# EasyEDA Pro project Cerberus_Sub_Controller_v01.eprj, schematic Cerberus_Sub_Controller_v01

## Sheets
1 A1: Create Date: 2024-08-08; Page Name: A1; Project Name: Cerberus_Sub_Controller_v01; Schematic Name: Cerberus_Sub_Controller_v01; Update Date: 2024-08-20; Company: 嘉立创EDA; Page Size: A3; Version: V1.0
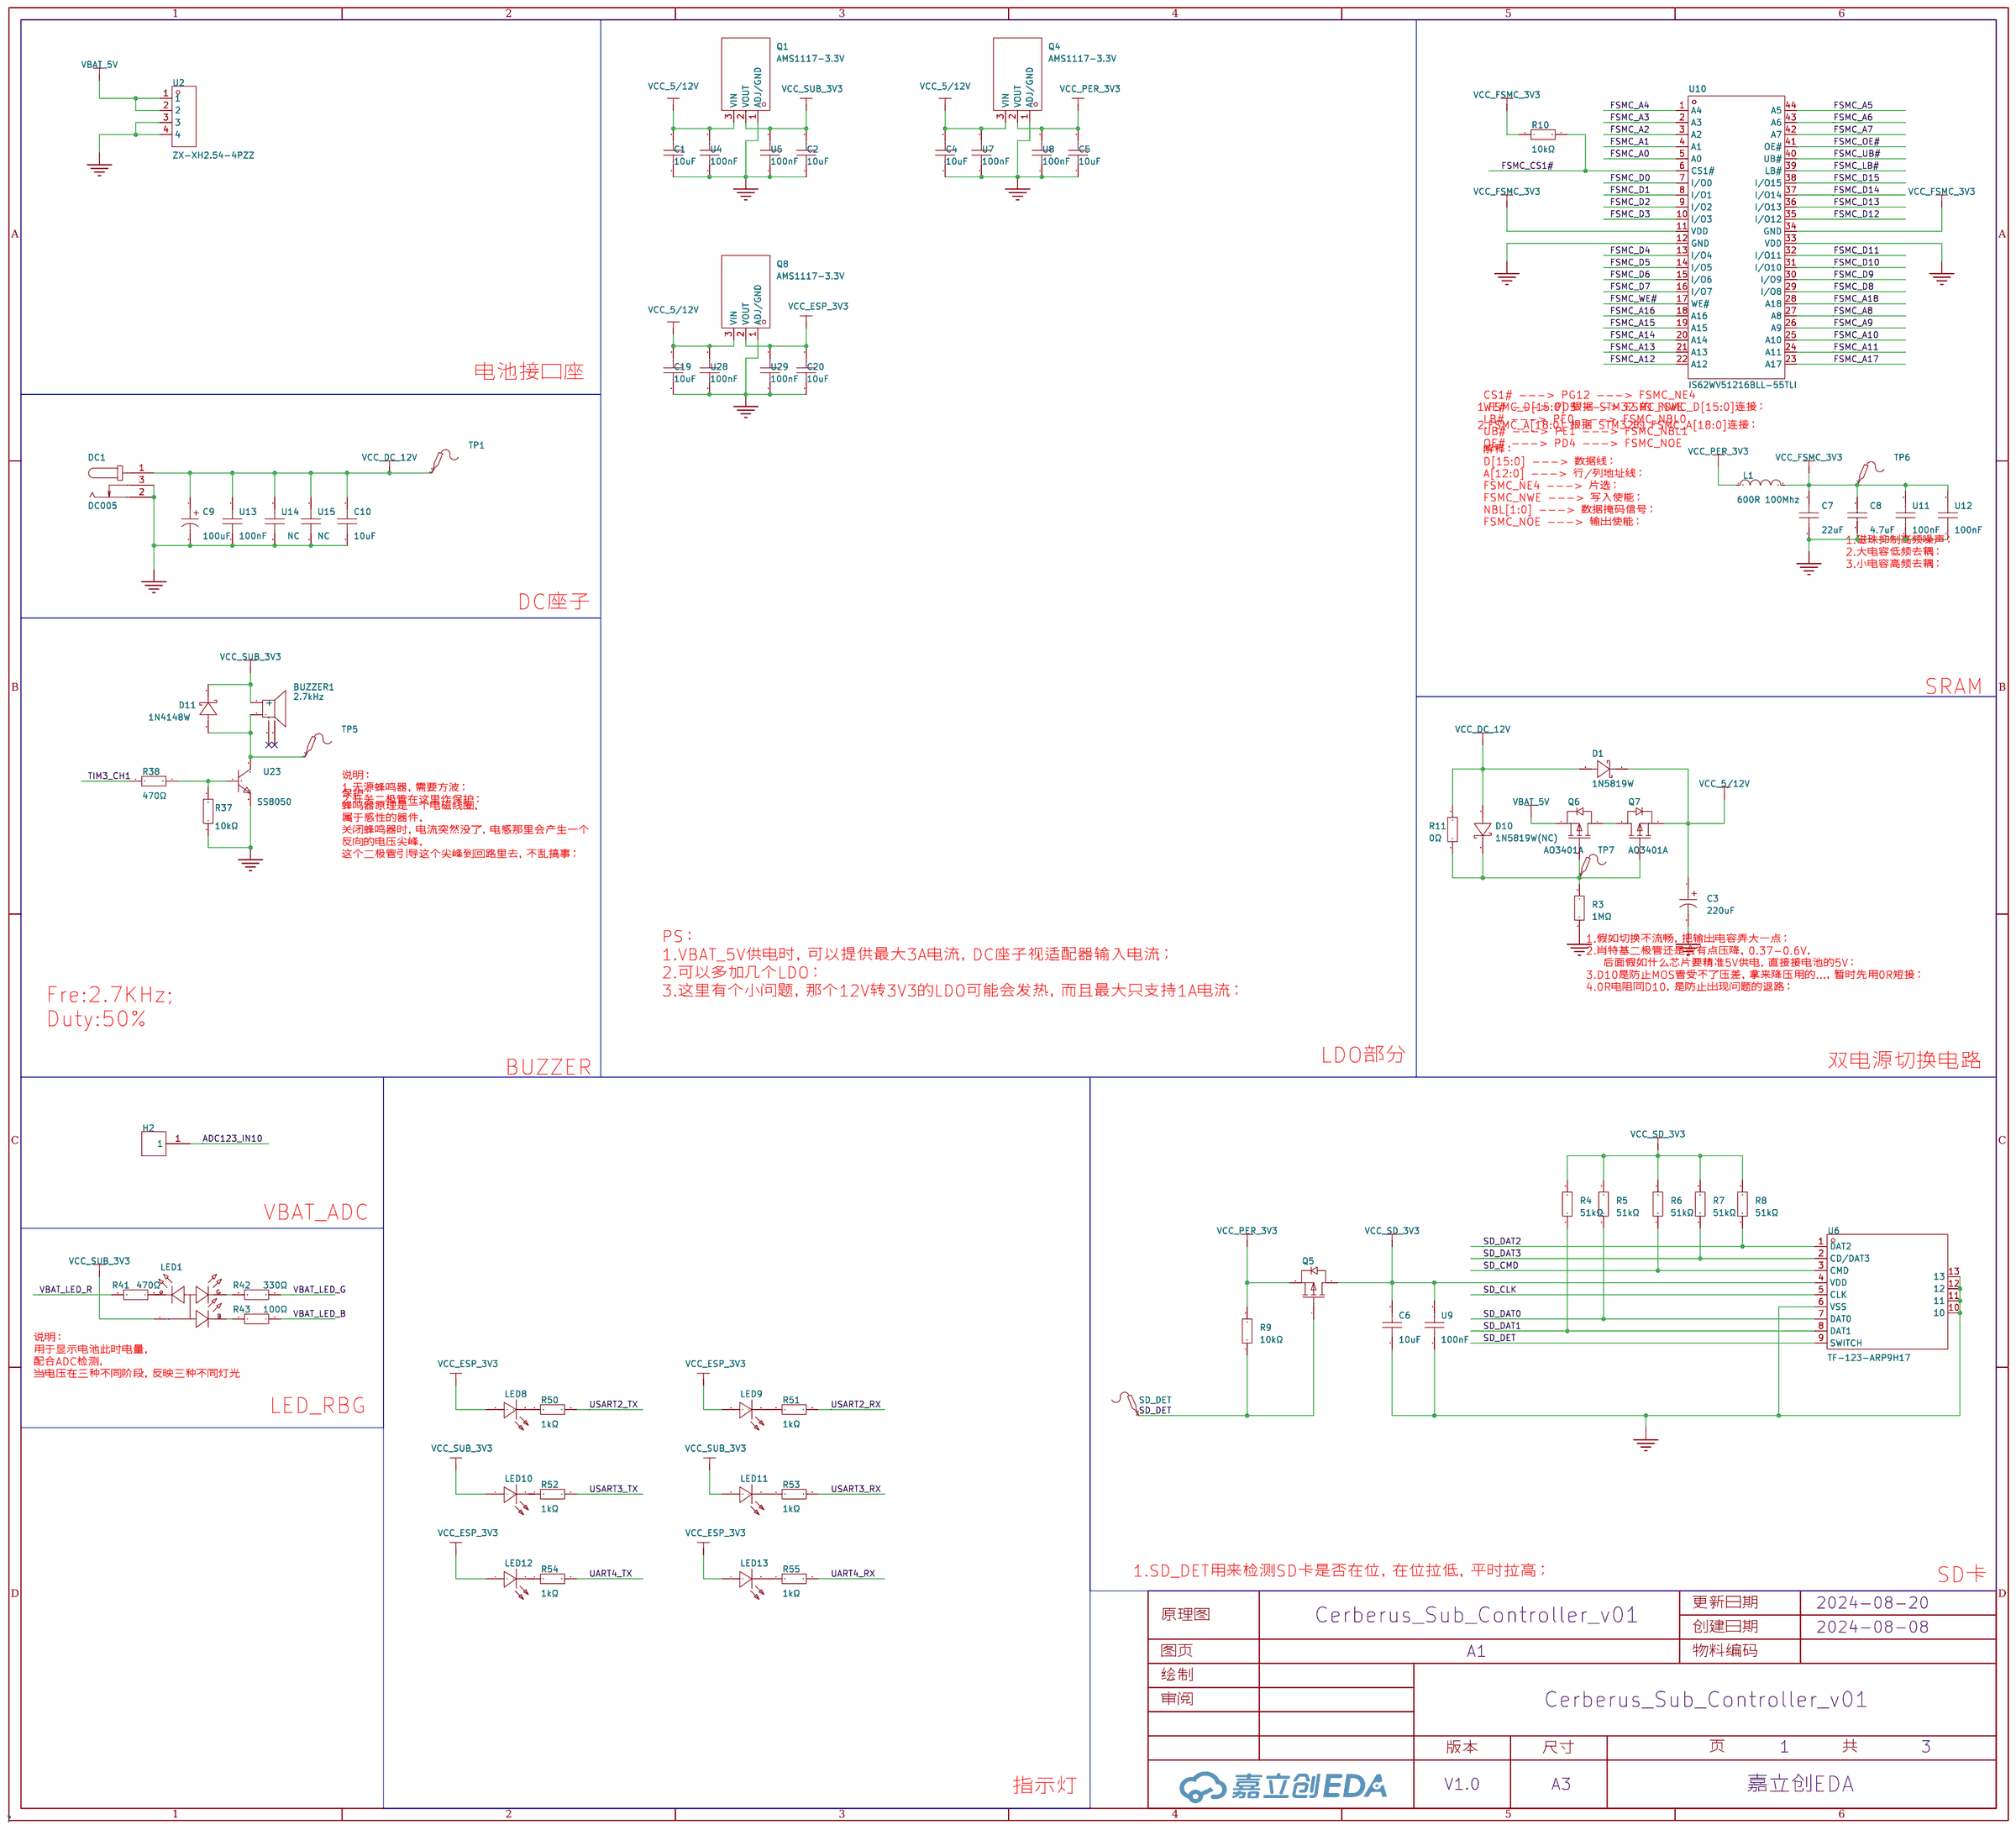
[diagram p0: A1]
2 A2: Page Name: A2; Update Date: 2024-08-17
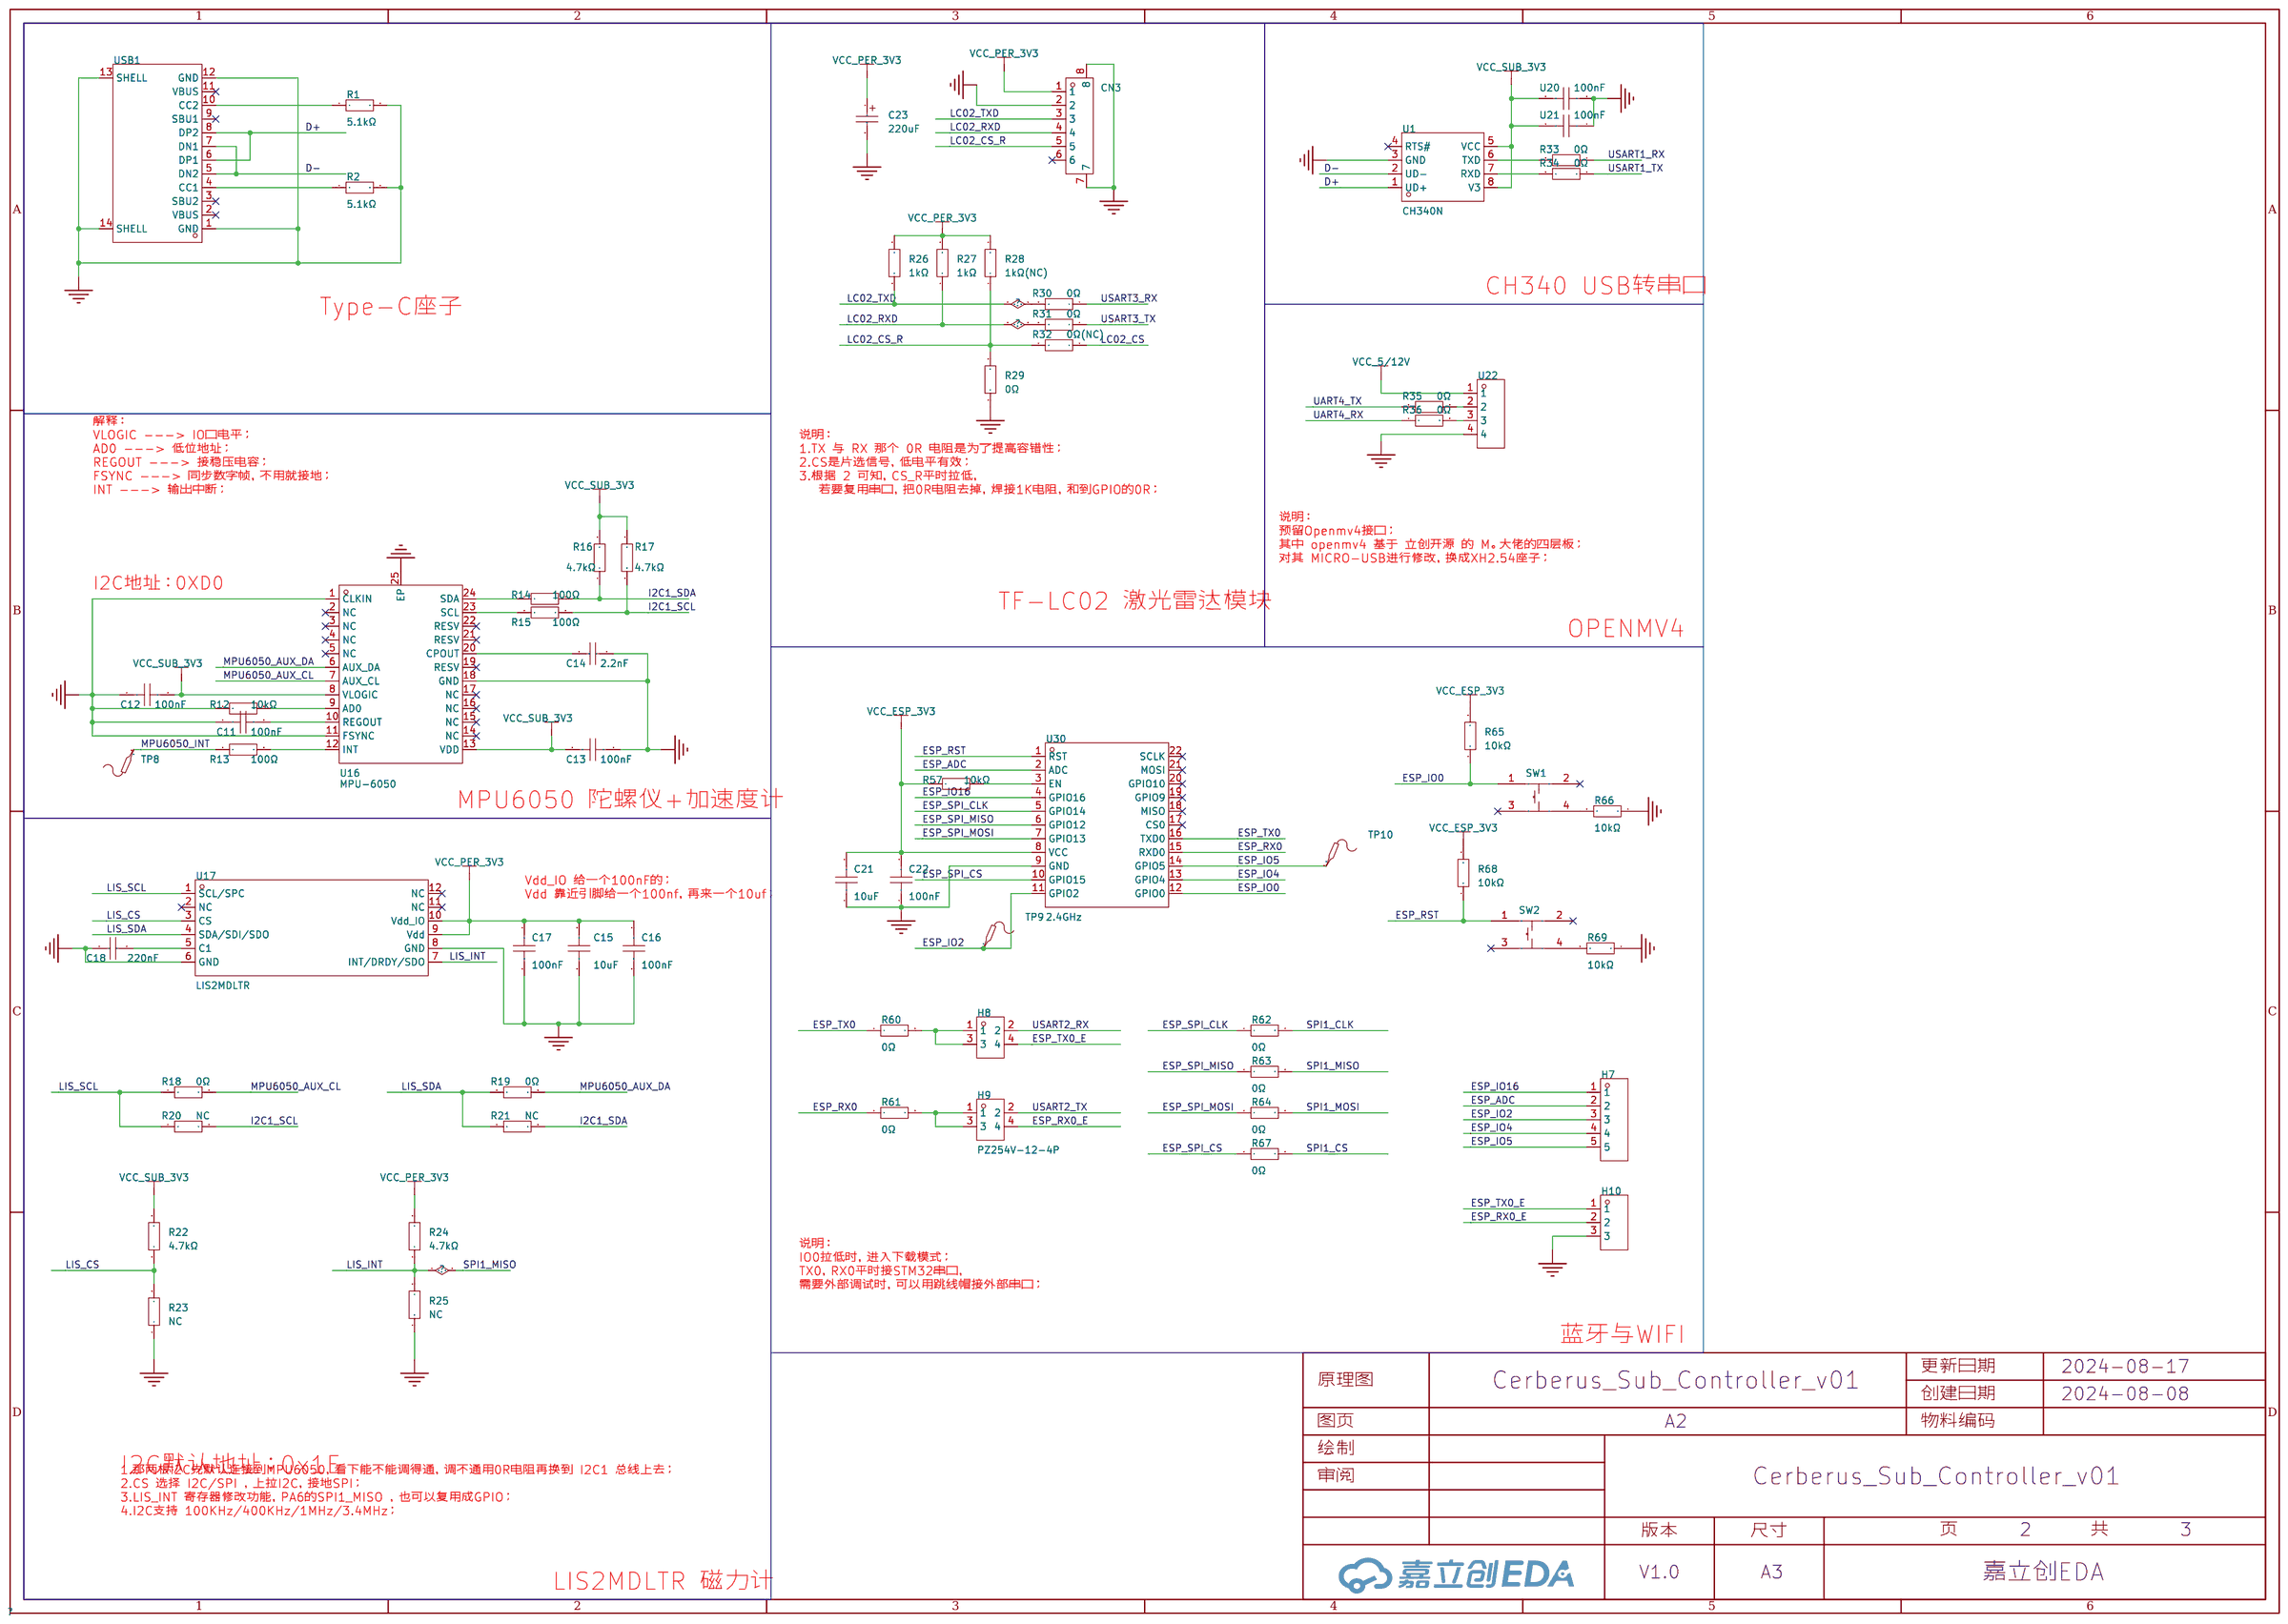
[diagram p1: A2]
3 A3: Page Name: A3.Cerberus_Sub_Controller_v01; Update Date: 2024-08-15
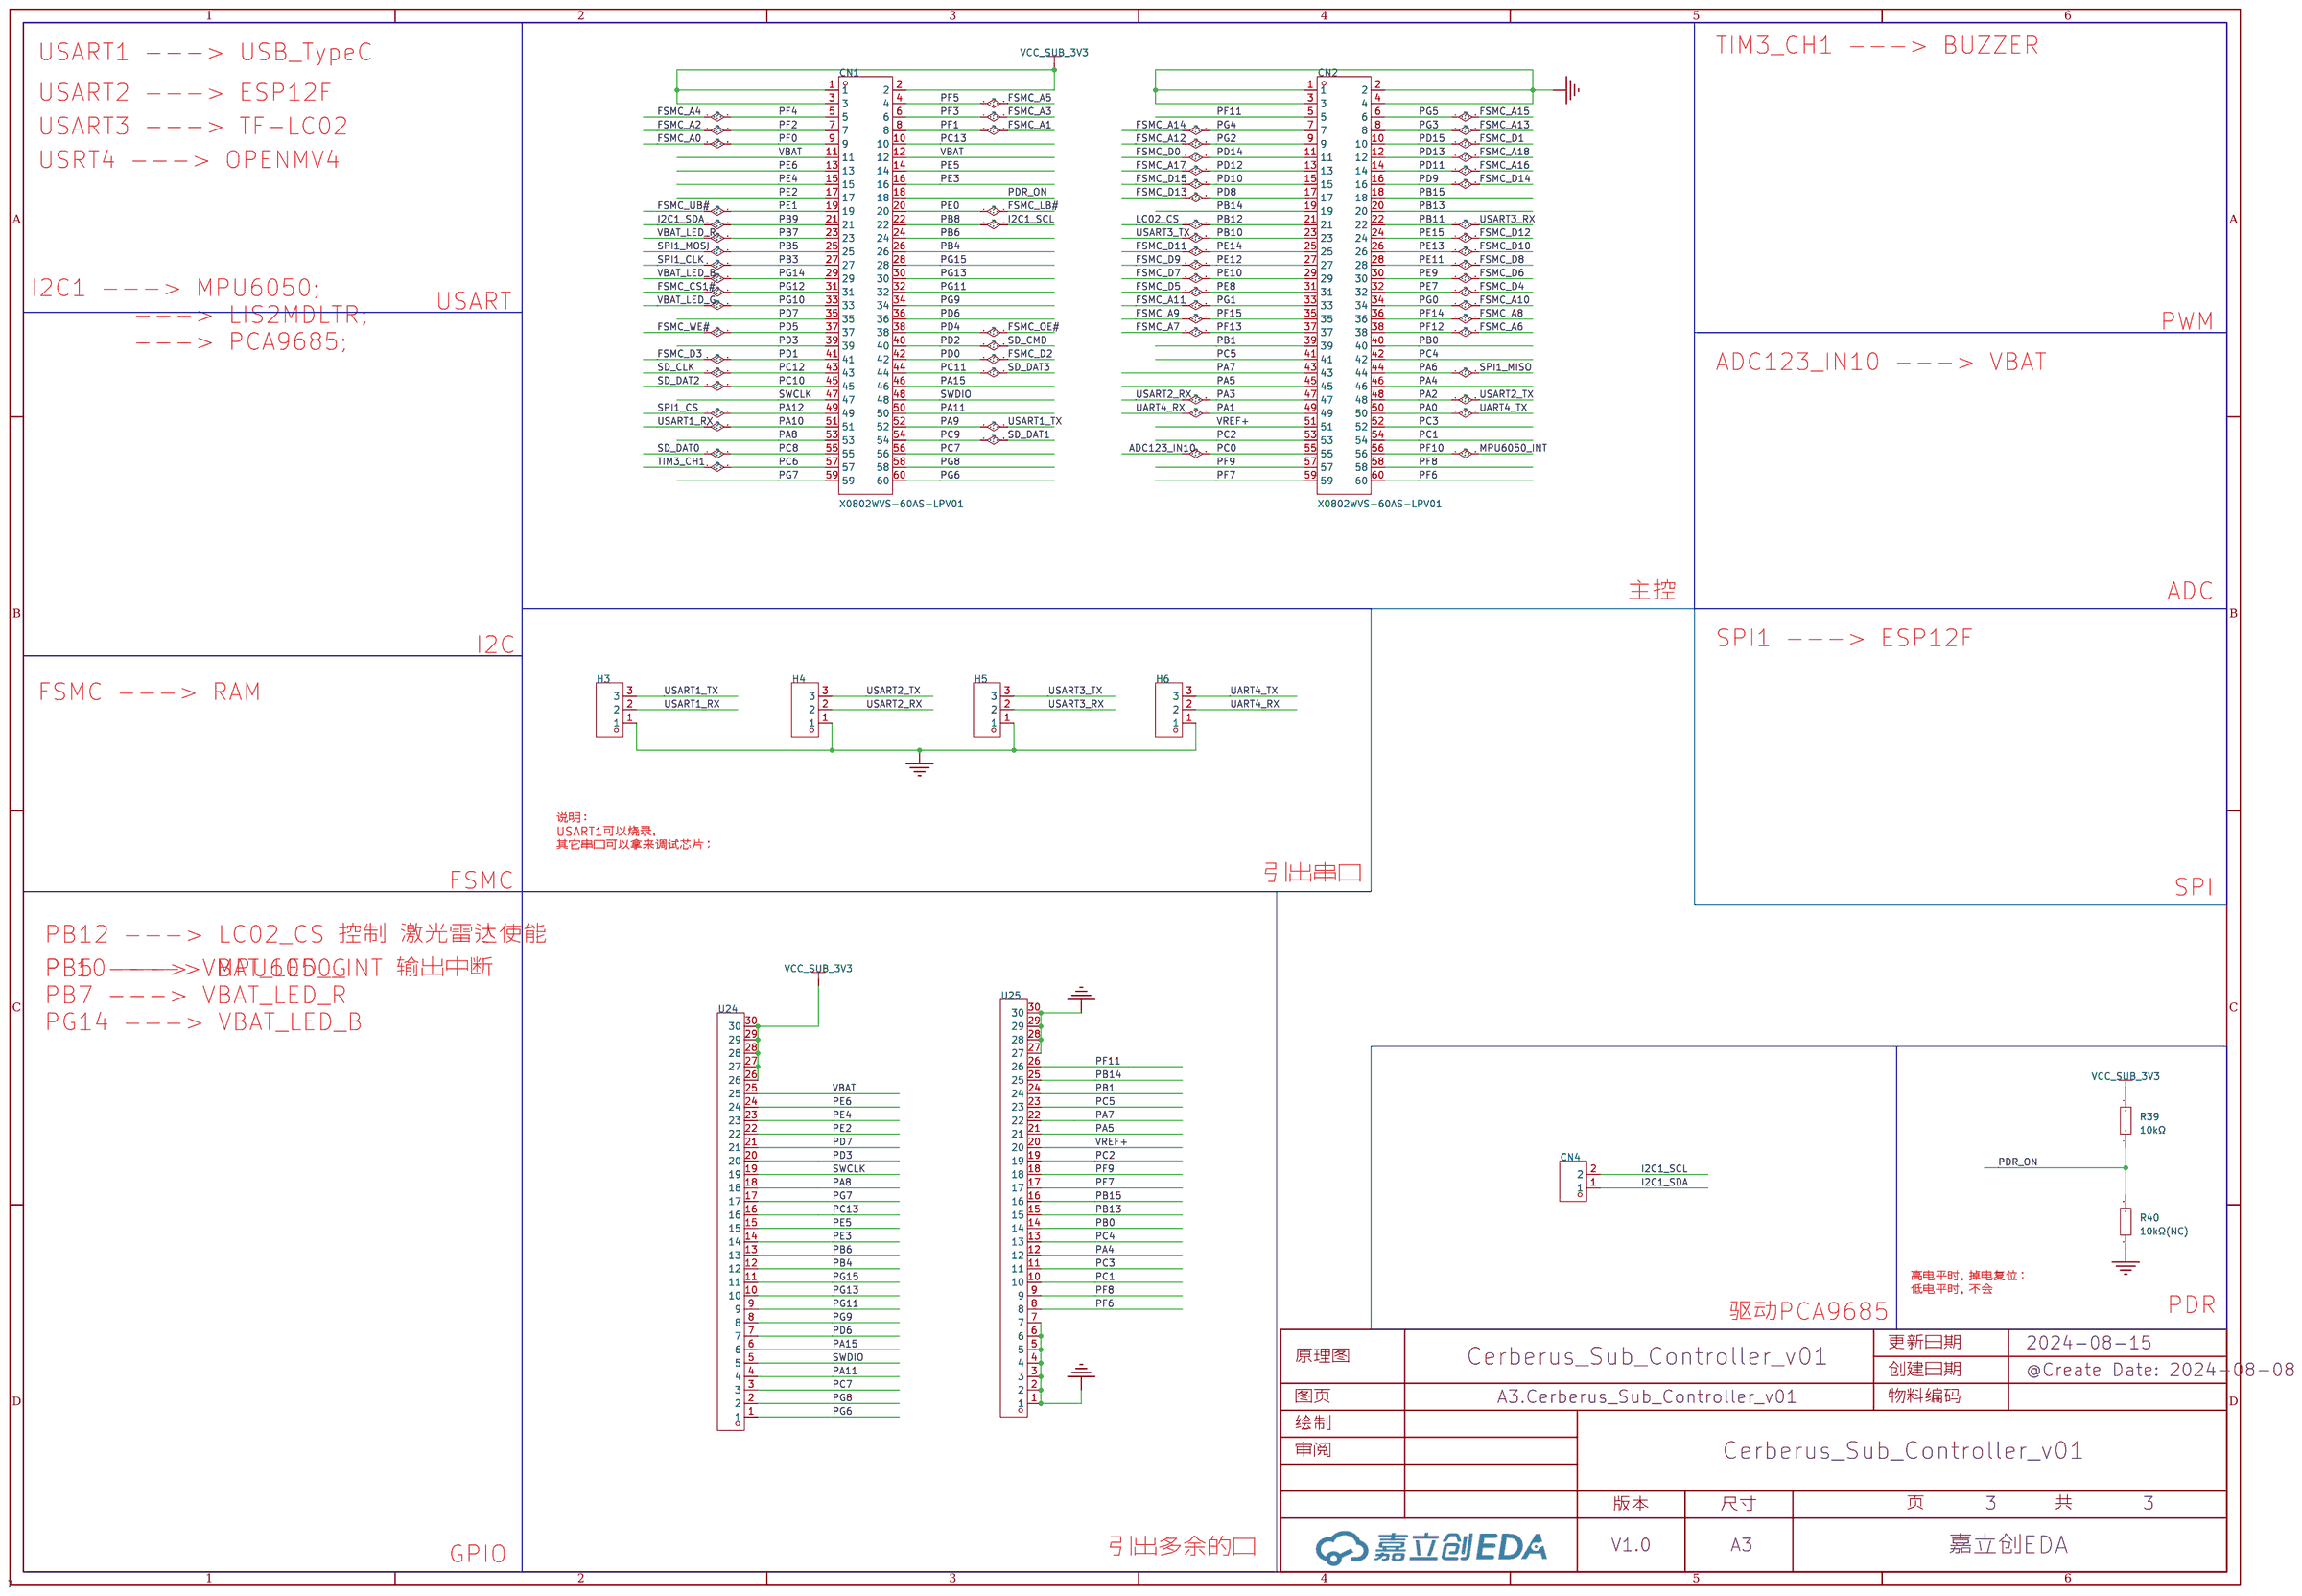
[diagram p2: A3]

## Parts
sheet A1
BUZZER1  2.7kHz  [BUZ-SMD_4P-L8.5-W8.5-P8.50-BR]
C1  10uF  [C0603]
C2  10uF  [C0603]
C3  220uF  [CAP-SMD_BD8.0-L8.3-W8.3-LS9.5-FD]
C4  10uF  [C0603]
C5  10uF  [C0603]
C6  10uF  [C0603]
C7  22uF  [C0603]
C8  4.7uF  [C0603]
C9  100uF  [CAP-SMD_BD6.3-L6.6-W6.6-LS7.4-FD]
C10  10uF  [C0603]
C19  10uF  [C0603]
C20  10uF  [C0603]
D1  1N5819W  [SOD-123_L2.7-W1.6-LS3.7-R-RD]
D10  1N5819W(NC)  [SOD-123_L2.7-W1.6-LS3.7-R-RD]
D11  1N4148W  [SOD-123_L2.7-W1.6-LS3.7-FD]
DC1  DC005  [DC-IN-TH_DC005]
H2  PZ254V-11-01P  [HDR-TH_1P-P2.54-V-M]
L1  600R 100Mhz  [L0603]
LED1  TZ-P4-1615RGBTCA1-0.55T  [LED-SMD_4P-L1.6-W1.5-BR_TZ-P4-1615]
LED8  NCD0805R1  [LED0805-R-RD]
LED9  NCD0805R1  [LED0805-R-RD]
LED10  NCD0805R1  [LED0805-R-RD]
LED11  NCD0805R1  [LED0805-R-RD]
LED12  NCD0805R1  [LED0805-R-RD]
LED13  NCD0805R1  [LED0805-R-RD]
Q1  AMS1117-3.3V  [SOT-89-3_L4.5-W2.5-P1.50-LS4.2-BR]
Q4  AMS1117-3.3V  [SOT-89-3_L4.5-W2.5-P1.50-LS4.2-BR]
Q5  SI2305CDS-T1-GE3  [SOT-23-3_L2.9-W1.3-P1.90-LS2.4-BR]
Q6  AO3401A  [SOT-23_L2.9-W1.3-P1.90-LS2.4-BR]
Q7  AO3401A  [SOT-23_L2.9-W1.3-P1.90-LS2.4-BR]
Q8  AMS1117-3.3V  [SOT-89-3_L4.5-W2.5-P1.50-LS4.2-BR]
R3  1MΩ  [R0402]
R4  51kΩ  [R0603]
R5  51kΩ  [R0603]
R6  51kΩ  [R0603]
R7  51kΩ  [R0603]
R8  51kΩ  [R0603]
R9  10kΩ  [R0603]
R10  10kΩ  [R0603]
R11  0Ω  [R0603]
R37  10kΩ  [R0603]
R38  470Ω  [R0603]
R41  470Ω  [R0603]
R42  330Ω  [R0603]
R43  100Ω  [R0603]
R50  1kΩ  [R0603]
R51  1kΩ  [R0603]
R52  1kΩ  [R0603]
R53  1kΩ  [R0603]
R54  1kΩ  [R0603]
R55  1kΩ  [R0603]
SD_DET  -  [Test-Point-0.5mm]
TP1  -  [Test-Point-0.5mm]
TP5  -  [Test-Point-0.5mm]
TP6  -  [Test-Point-0.5mm]
TP7  -  [Test-Point-0.5mm]
U2  ZX-XH2.54-4PZZ  [CONN-TH_4P-P2.50_4PIN]
U4  100nF  [C0603]
U5  100nF  [C0603]
U6  TF-123-ARP9H17  [TF-SMD_TF-123-ARP9H15]
U7  100nF  [C0603]
U8  100nF  [C0603]
U9  100nF  [C0603]
U10  IS62WV51216BLL-55TLI  [TSOP-44_L18.4-W10.2-P0.80-LS11.8-BL]
U11  100nF  [C0603]
U12  100nF  [C0603]
U13  100nF  [C0603]
U14  NC  [C0603]
U15  NC  [C0603]
U23  SS8050  [SOT-23-3_L2.9-W1.3-P1.90-LS2.4-BR]
U28  100nF  [C0603]
U29  100nF  [C0603]
sheet A2
C11  100nF  [C0402]
C12  100nF  [C0402]
C13  100nF  [C0402]
C14  2.2nF  [C0402]
C15  10uF  [C0402]
C16  100nF  [C0402]
C17  100nF  [C0402]
C18  220nF  [C0402]
C21  10uF  [C0603]
C22  100nF  [C0603]
C23  220uF  [CAP-SMD_L3.5-W2.8-R-RD]
CN3  WAFER-SH1.0-6PWB  [CONN-SMD_6P-P1.00_XUNPU_WAFER-SH1.0-6PWB]
H7  PZ254V-11-05P  [HDR-TH_5P-P2.54-V-M]
H8  PZ254V-12-4P  [HDR-TH_4P-P2.54-V-M-R2-C2-S2.54]
H9  PZ254V-12-4P  [HDR-TH_4P-P2.54-V-M-R2-C2-S2.54]
H10  PZ254V-11-03P  [HDR-TH_3P-P2.54-V-M]
R1  5.1kΩ  [R0603]
R2  5.1kΩ  [R0603]
R12  10kΩ  [R0402]
R13  100Ω  [R0402]
R14  100Ω  [R0402]
R15  100Ω  [R0402]
R16  4.7kΩ  [R0603]
R17  4.7kΩ  [R0603]
R18  0Ω  [R0402]
R19  0Ω  [R0402]
R20  NC  [R0402]
R21  NC  [R0402]
R22  4.7kΩ  [R0402]
R23  NC  [R0402]
R24  4.7kΩ  [R0402]
R25  NC  [R0402]
R26  1kΩ  [R0603]
R27  1kΩ  [R0603]
R28  1kΩ(NC)  [R0603]
R29  0Ω  [R0603]
R30  0Ω  [R0603]
R31  0Ω  [R0603]
R32  0Ω(NC)  [R0603]
R33  0Ω  [R0603]
R34  0Ω  [R0603]
R35  0Ω  [R0603]
R36  0Ω  [R0603]
R57  10kΩ  [R0603]
R60  0Ω  [R0603]
R61  0Ω  [R0603]
R62  0Ω  [R0603]
R63  0Ω  [R0603]
R64  0Ω  [R0603]
R65  10kΩ  [R0603]
R66  10kΩ  [R0603]
R67  0Ω  [R0603]
R68  10kΩ  [R0603]
R69  10kΩ  [R0603]
SW1  TS-1009S-04526  [SW-SMD_4P-L4.5-W4.5-P3.00-LS7.0]
SW2  TS-1009S-04526  [SW-SMD_4P-L4.5-W4.5-P3.00-LS7.0]
TP8  -  [Test-Point-0.5mm]
TP9  -  [Test-Point-0.5mm]
TP10  -  [Test-Point-0.5mm]
U1  CH340N  [SOP-8_L4.9-W3.9-P1.27-LS6.0-BL]
U16  MPU-6050  [QFN-24_L4.0-W4.0-P0.50-BL-EP2.7]
U17  LIS2MDLTR  [LGA-12_L2.0-W2.0-P0.50-BL]
U20  100nF  [C0603]
U21  100nF  [C0603]
U22  ZX-XH2.54-4PZZ  [CONN-TH_4P-P2.50_4PIN]
U30  2.4GHz  [WIFIM-SMD_ESP-12F-ESP8266MOD]
USB1  TYPE-C 16PIN 2MD(073)  [USB-C-SMD_TYPE-C-6PIN-2MD-073]
sheet A3
CN1  X0802WVS-60AS-LPV01  [CONN-SMD_60P-P0.80_XKB_X0802WVS-60ADS-LPV01]
CN2  X0802WVS-60AS-LPV01  [CONN-SMD_60P-P0.80_XKB_X0802WVS-60ADS-LPV01]
CN4  ZX-XH2.54-2PZZ  [CONN-TH_2P-P2.50_HX25003-2A]
H3  PZ254V-11-03P  [HDR-TH_3P-P2.54-V-M]
H4  PZ254V-11-03P  [HDR-TH_3P-P2.54-V-M]
H5  PZ254V-11-03P  [HDR-TH_3P-P2.54-V-M]
H6  PZ254V-11-03P  [HDR-TH_3P-P2.54-V-M]
R39  10kΩ  [R0603]
R40  10kΩ(NC)  [R0603]
U24  X6511WV-30H-C60D30  [HDR-TH_30P-P2.54-V-M]
U25  X6511WV-30H-C60D30  [HDR-TH_30P-P2.54-V-M]

## Library data of the parts
BUZZER1 = MLT-8530_C94599: 驱动方式:无源(外部驱动);构造类型:电磁式;频率:2.7kHz;声压(SPL):80dB@5V,10cm;; LCSC Part Name: MLT-8530; Supplier Part: C94599; Manufacturer: 华能; Manufacturer Part: MLT-8530; Supplier Footprint: SMD,8.5x8.5mm; JLCPCB Part Class: 扩展库; Datasheet: https://atta.szlcsc.com/upload/public/pdf/source/20170522/1495448322339.pdf; Supplier: LCSC; Oscillator Circuit: 无源(外部驱动); Technology Type: 电磁式; Operating Voltage: 2.5V~4.5V; Sound Pressure Level (SPL): 80dB@5V,10cm; Length: 8.5mm; Width: 8.5mm; Height: 3.3mm
C1 C2 C4-C6 C10 C19 C20 = CL10A106MA8NRNC: 容值:10uF;精度:±20%;额定电压:25V;材质(温度系数):X5R;; LCSC Part Name: 10uF ±20% 25V; Supplier Part: C96446; Manufacturer: SAMSUNG(三星); Supplier Footprint: 0603; JLCPCB Part Class: 基础库; Datasheet: https://atta.szlcsc.com/upload/public/pdf/source/20160218/1457707763339.pdf; Supplier: LCSC; Tolerance: ±20%; Voltage Rated: 25V; Temperature Coefficient: X5R
C3 = 189RV0056: 容值:220uF;精度:±20%;额定电压:50V;纹波电流:670mA;等效串联电阻:180mΩ;; LCSC Part Name: 220uF ±20% 50V; Supplier Part: C18203136; Manufacturer: KNSCHA(科尼盛); Supplier Footprint: SMD,D8xL10.5mm; JLCPCB Part Class: 扩展库; Datasheet: https://atta.szlcsc.com/upload/public/pdf/source/20231106/5AE315A6731E5CA26058374364E4B37B.pdf; Supplier: LCSC; Tolerance: ±20%; Rated Voltage: 50V; Ripple Current: 670mA; Equivalent Series Resistance(ESR): 180mΩ; φD: 8mm; L: 10.5mm; Lifetime @ Temp: 5000hrs@105℃; Operating Temperature: -55℃~+105℃
C7 = CGA0603X5R226M160JT: 容值:22uF;精度:±20%;额定电压:16V;材质(温度系数):X5R;; LCSC Part Name: 22uF ±20% 16V; Supplier Part: C6119868; Manufacturer: HRE(芯声); Supplier Footprint: 0603; JLCPCB Part Class: 扩展库; Supplier: LCSC; Tolerance: ±20%; Voltage Rated: 16V; Temperature Coefficient: X5R
C8 = CL10A475KO8NNNC: 容值:4.7uF;精度:±10%;额定电压:16V;材质(温度系数):X5R;; LCSC Part Name: 4.7uF ±10% 16V; Supplier Part: C19666; Manufacturer: SAMSUNG(三星); Supplier Footprint: 0603; JLCPCB Part Class: 基础库; Datasheet: https://atta.szlcsc.com/upload/public/pdf/source/20160218/1457707763339.pdf; Supplier: LCSC; Tolerance: ±10%; Voltage Rated: 16V; Temperature Coefficient: X5R
C9 = RVT100UF35V67RV0034: 容值:100uF;精度:±20%;额定电压:35V;纹波电流:87mA@120kHz;等效串联电阻:-;; LCSC Part Name: 100uF ±20% 35V; Supplier Part: C2836442; Manufacturer: KNSCHA(科尼盛); Supplier Footprint: SMD,D6.3xL7.7mm; JLCPCB Part Class: 扩展库; Datasheet: https://atta.szlcsc.com/upload/public/pdf/source/20210528/C2836442_7F6389BF36F63F32D6DF3A507E8E95D6.pdf; Supplier: LCSC; Tolerance: ±20%; Rated Voltage: 35V; Ripple Current: 87mA@120kHz; φD: 6.3mm; L: 7.7mm; Lifetime @ Temp: 2000hrs@105℃; Operating Temperature: -55℃~+105℃
D1 D10 = 1N5819W_C963381: 二极管配置:独立式;正向压降(Vf):600mV@200mA;直流反向耐压(Vr):40V;平均整流电流(Io):350mA;; LCSC Part Name: 电压:40V 电流:350mA; Supplier Part: C963381; Manufacturer: JSMSEMI(杰盛微); Supplier Footprint: SOD-123; JLCPCB Part Class: 扩展库; Datasheet: https://atta.szlcsc.com/upload/public/pdf/source/20230807/ADD53622154D5B572F84A7B877E922CE.pdf; Supplier: LCSC; Diode Configuration: 独立式; Forward Voltage (Vf@If): 600mV@200mA; Reverse Voltage (Vr): 40V; Average Rectified Current (Io): 350mA; Reverse Leakage Current (Ir): 5uA@30V
D11 = 1N4148W_C7420318: 二极管配置:独立式;正向压降(Vf):1.25V@150mA;直流反向耐压(Vr):100V;平均整流电流(Io):150mA;功率:400mW;反向恢复时间(trr):4ns;; LCSC Part Name: 电压:100V 电流:150mA; Supplier Part: C7420318; Manufacturer: 宏迦橙; Supplier Footprint: SOD-123; JLCPCB Part Class: 扩展库; Datasheet: https://atta.szlcsc.com/upload/public/pdf/source/20230828/E5C3F7A4272052930A7E03B75759BF50.pdf; Supplier: LCSC; Diode Configuration: 独立式; Forward Voltage (Vf@If): 1.25V@150mA; Reverse Voltage (Vr): 100V; Average Rectified Current (Io): 150mA; Power Dissipation: 400mW; Reverse Leakage Current: 1uA@75V; Reverse Recovery Time (trr): 4ns; Operating Temperature: -55℃~+150℃
DC1 = DC005: 连接器类型:DC电源插座;安装方式:弯插;触点内径:2mm;触点外径:6.3mm;额定电流:500mA;额定电压:30V;工作温度范围:-40℃~+55℃;; LCSC Part Name: DC电源插座 内径:2mm 外径:6.3mm; Supplier Part: C431533; Manufacturer: SHOU HAN(首韩); Supplier Footprint: 插件; JLCPCB Part Class: 扩展库; Datasheet: https://atta.szlcsc.com/upload/public/pdf/source/20190925/C431533_4751811035784AC1D38EBC85F7905E99.pdf; Supplier: LCSC; Connector Type: DC电源插座; Mounting Style: 弯插; Inside Contact Diameter: 2mm; Outside Contact Diameter: 6.3mm; Current Rating (Max): 500mA; Voltage Rating (Max): 30V; Operating Temperature Range: -40℃~+55℃
H2 = PZ254V-11-01P: 插针结构:1x1P;间距:2.54mm;行距:-;圆针/方针:方针;安装类型:直插;排数:单排;总PIN位数:1P;额定电流:-;额定电压:-;配合针长度:6mm;塑高:2.5mm;端接针长度:3mm;触头材质:黄铜;触头镀层:-;工作温度范围:-40℃~+105℃;颜色:黑色;; LCSC Part Name: 间距:2.54mm 1x1P 直插 方针; Supplier Part: C492400; Manufacturer: XFCN(兴飞); Supplier Footprint: 插件,P=2.54mm; JLCPCB Part Class: 扩展库; Datasheet: https://atta.szlcsc.com/upload/public/pdf/source/20200309/C492400_46876A5B545F5AE6B8D4A09C46E276E8.pdf; Supplier: LCSC; Pin Structure: 1x1P; Pitch: 2.54mm; Circluar Pins/Square Pins: 方针; Mounting Type: 直插; Number of Rows: 单排; Number of Pins: 1P; Length of Mating Pin: 6mm; Insulation Height: 2.5mm; Length of End Connection Pin: 3mm; Contact Material: 黄铜; Operating Temperature Range: -40℃~+105℃; Color: 黑色
L1 = BLM18AG601SN1D: 标称阻抗@测试频率:600Ω@100MHz;误差:±25%;直流电阻(RDC):380mΩ;; LCSC Part Name: 单路 0603磁珠 阻抗600Ω@100MHz; Supplier Part: C19330; Manufacturer: muRata(村田); Supplier Footprint: 0603; JLCPCB Part Class: 扩展库; Datasheet: https://atta.szlcsc.com/upload/public/pdf/source/20180329/C160981_FD3C2D2622A377E203B89F4AA32B0741.pdf; Supplier: LCSC; Impedance @ Frequency: 600Ω@100MHz; Tolerance: ±25%; DC Resistance: 380mΩ; Current Rating: 500mA; Circuits: 1
LED1 = TZ-P4-1615RGBTCA1-0.55T: LCSC Part Name: RGB三色; Supplier Part: C779813; Manufacturer: TUOZHAN(拓展光电); Supplier Footprint: 0606; JLCPCB Part Class: 扩展库; Datasheet: https://atta.szlcsc.com/upload/public/pdf/source/20200902/C779813_C8BF794AA7930C547AC040747DB40629.pdf; Supplier: LCSC
LED8-LED13 = NCD0805R1: 灯头类型:-;发光颜色:红色;正向电压(VF):1.6V~2.6V;功率:65mW;正向电流:20mA;主波长:615nm~630nm;二极管配置:独立二极管;透镜颜色:无色透明透镜;色温:-;发光强度:67mcd~195mcd;发光角度:130°;载带方式:-;工作温度:-30℃~+85℃;; Supplier Part: C84256; Manufacturer: 国星光电; Supplier Footprint: 0805; JLCPCB Part Class: 基础库; Datasheet: https://atta.szlcsc.com/upload/public/pdf/source/20200820/C84256_F0A75A43B3EAD75808600A0514C76B99.pdf; Supplier: LCSC; Emitted Color: 红色; Forward Voltage (VF): 1.6V~2.6V; Power Dissipation: 65mW; Forward Current: 20mA; Dominant Wavelength: 615nm~630nm; Diode Configuration: 独立二极管; Lens Color: 无色透明透镜; Luminous Intensity: 67mcd~195mcd; Viewing Angle: 130°; Operating Temperature: -30℃~+85℃